# EAGLE design Dev-PCB (EAGLE 6.6.0) (continued)
## Board (continued)
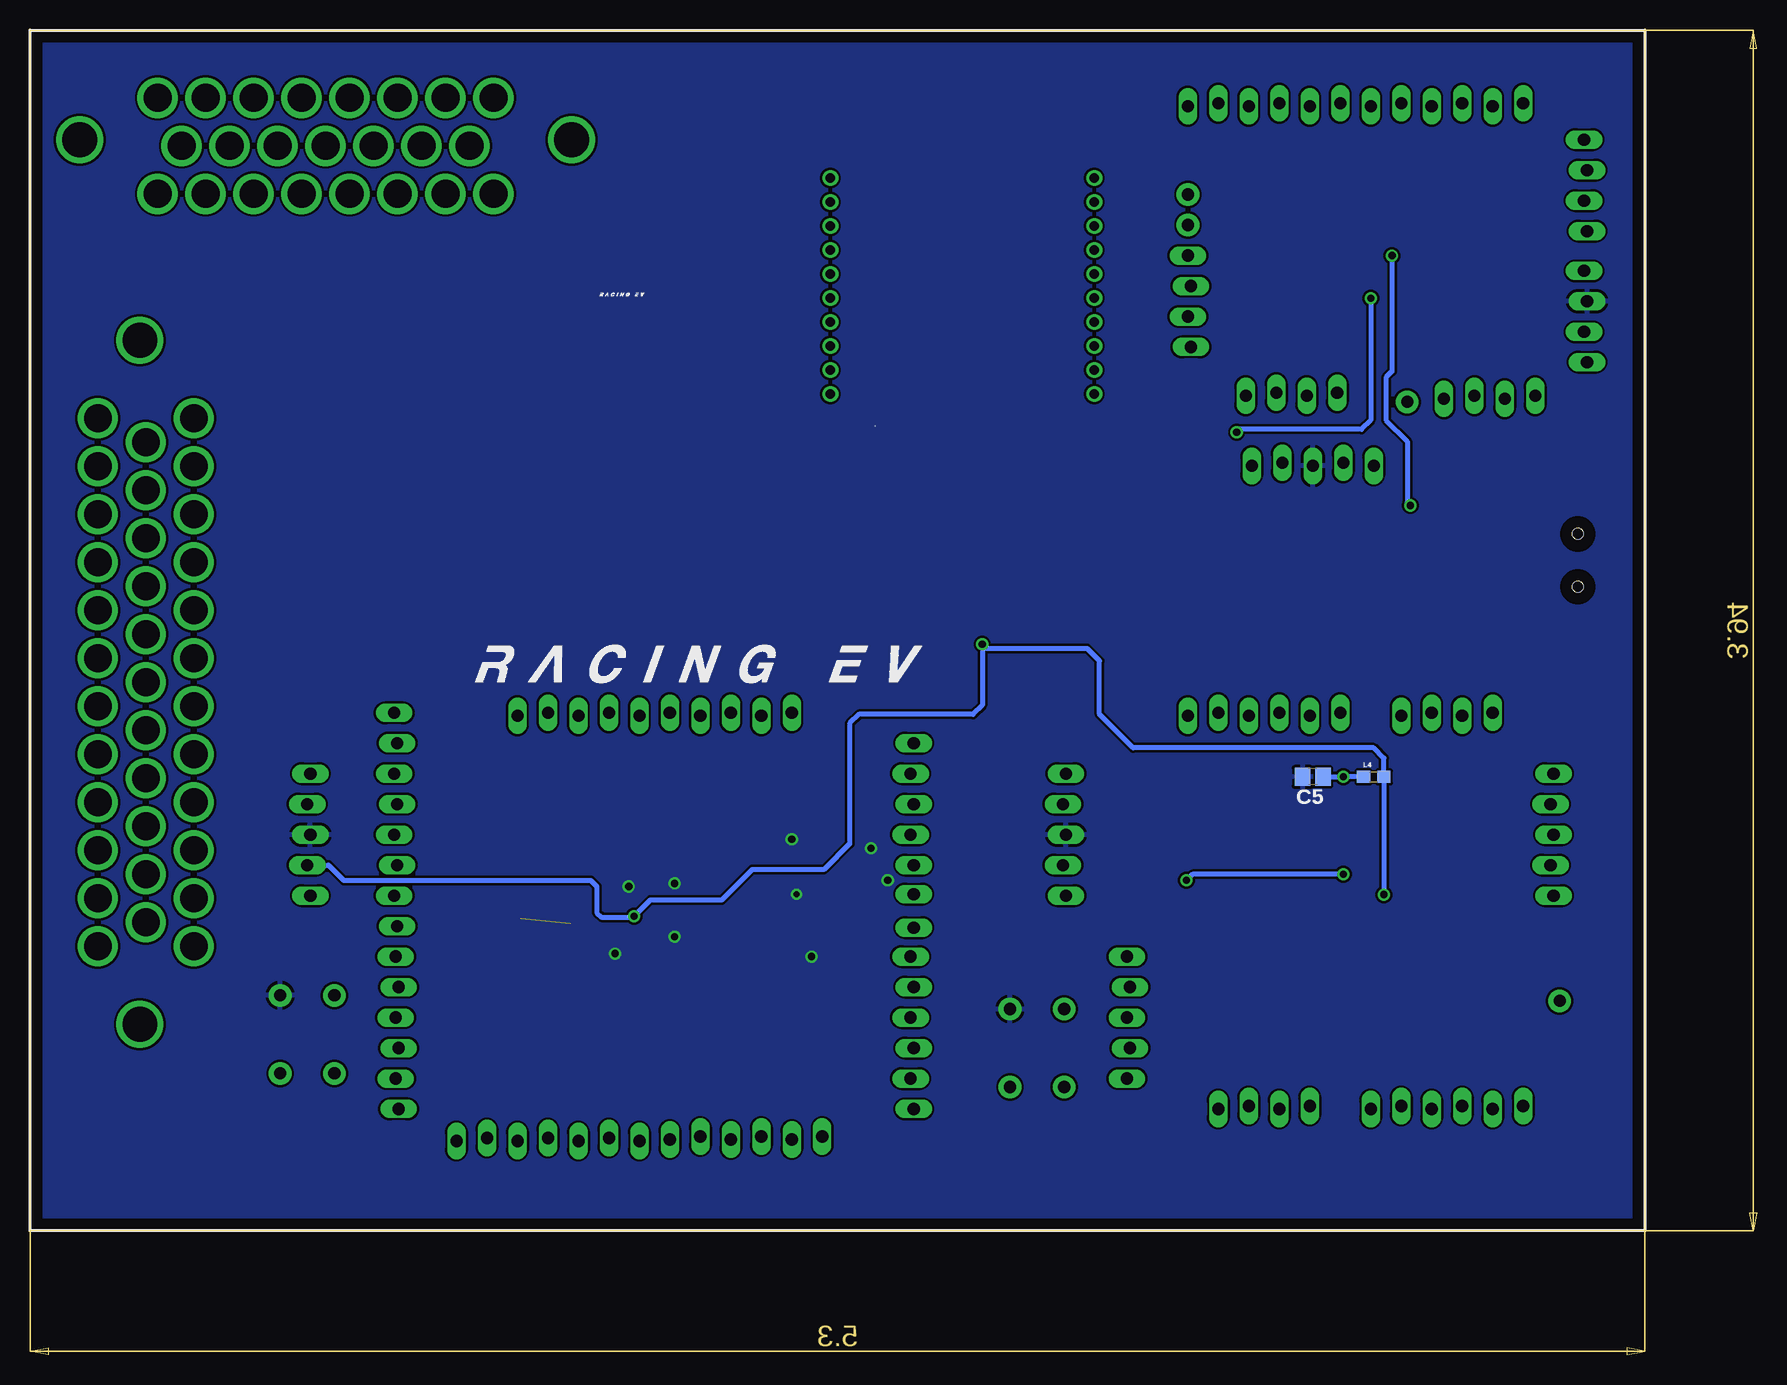
[diagram p3: board, bottom side, seen from below]

Size 134.62 x 100.08 mm. Coordinates in mm from the lower left corner, seen from the top.
Outline: 0,0 134.62,0 134.62,100.08 0,100.08 0,0
Copper layers (1*16): Top 0.035mm / dielectric 1.5mm / Bottom 0.035mm
Design rules "default": minimum track width 10mil, minimum drill 24mil, track to track 8mil, track to pad 8mil, pad to pad 8mil, via to via 8mil, smd to smd 8mil, copper to edge 40mil, drill to drill 8mil, minimum pad ring 10mil, minimum via ring 8mil, stop-mask expansion 4mil, vias tented up to drill 0mil, thermal gap 10mil

### Footprints (pad centres in the part's own frame; a part is rotated, then mirrored left to right if it is on the bottom)
C0805 = smd 1.3 x 1.5: 1 -0.85,0; 2 0.85,0
EIA3216 = smd 1.4 x 1.6: A 1.4,0; C -1.4,0
EIA7343 = smd 2.55 x 2.7: A 3.17,0; C -3.17,0
0805 = smd 0.8 x 1.2: 1 -0.9,0; 2 0.9,0
1-770669-1 = drill 2.35: 1 -14,4; 2 -10,4; 3 -6,4; 4 -2,4; 5 2,4; 6 6,4; 7 10,4; 8 14,4; 9 -12,0; 10 -8,0; 11 -4,0; 12 0,0; 13 4,0; 14 8,0; 15 12,0; 16 -14,-4; 17 -10,-4; 18 -6,-4; 19 -2,-4; 20 2,-4; 21 6,-4; 22 10,-4; 23 14,-4 | drill 2.9: 24 -20.5,-0.5; 25 20.5,-0.5
1-776163-2 = drill 2.3: 1 -22,4; 2 -18,4; 3 -14,4; 4 -10,4; 5 -6,4; 6 -2,4; 7 2,4; 8 6,4; 9 10,4; 10 14,4; 11 18,4; 12 22,4; 13 -20,0; 14 -16,0; 15 -12,0; 16 -8,0; 17 -4,0; 18 0,0; 19 4,0; 20 8,0; 21 12,0; 22 16,0; 23 20,0; 24 -22,-4; 25 -18,-4; 26 -14,-4; 27 -10,-4; 28 -6,-4; 29 -2,-4; 30 2,-4; 31 6,-4; 32 10,-4; 33 14,-4; 34 18,-4; 35 22,-4 | drill 2.88: TH1 -28.5,-0.5; TH2 28.5,-0.5
1X04_LOCK_LONGPADS = drill 1.016 long: 1 0,0; 2 2.54,-0.254; 3 5.08,0; 4 7.62,-0.254
1X05_LOCK_LONGPADS = drill 1.016 long: 1 0,0; 2 2.54,-0.254; 3 5.08,0; 4 7.62,-0.254; 5 10.16,0
1X01 = drill 1.016 pad 1.88: 1 0,0
1X06_LOCK_LONGPADS = drill 1.016 long: 1 0,0; 2 2.54,-0.254; 3 5.08,0; 4 7.62,-0.254; 5 10.16,0; 6 12.7,-0.254
1X08_LOCK_LONGPADS = drill 1.016 long: 1 0,0.127; 2 2.54,-0.127; 3 5.08,0.127; 4 7.62,-0.127; 5 10.16,0.127; 6 12.7,-0.127; 7 15.24,0.127; 8 17.78,-0.127
1X02_LOCK_LONGPADS = drill 1.016 long: 1 -0.127,0; 2 2.667,0
1X07_LOCK_LONGPADS = drill 1.016 long: 1 0,0.127; 2 2.54,-0.127; 3 5.08,0.127; 4 7.62,-0.127; 5 10.16,0.127; 6 12.7,-0.127; 7 15.24,0.127
0603 = smd 1.1 x 1: 1 -0.85,0; 2 0.85,0
CHIP-LED0805 = smd 1.2 x 1.2: A 0,-1.05; C 0,1.05
R0805 = smd 1.1 x 1.4: 1 -1,0; 2 1,0
TACTILE-PTH = drill 1.016 pad 1.88: 1 -3.251,2.261; 2 3.251,2.261; 3 -3.251,-2.261; 4 3.251,-2.261
TQFP-64 = smd 0.22 x 1: 1 -3.75,-5.75; 2 -3.25,-5.75; 3 -2.75,-5.75; 4 -2.25,-5.75; 5 -1.75,-5.75; 6 -1.25,-5.75; 7 -0.75,-5.75; 8 -0.25,-5.75; 9 0.25,-5.75; 10 0.75,-5.75; 11 1.25,-5.75; 12 1.75,-5.75; 13 2.25,-5.75; 14 2.75,-5.75; 15 3.25,-5.75; 16 3.75,-5.75; 33 3.75,5.75; 34 3.25,5.75; 35 2.75,5.75; 36 2.25,5.75; 37 1.75,5.75; 38 1.25,5.75; 39 0.75,5.75; 40 0.25,5.75; 41 -0.25,5.75; 42 -0.75,5.75; 43 -1.25,5.75; 44 -1.75,5.75; 45 -2.25,5.75; 46 -2.75,5.75; 47 -3.25,5.75; 48 -3.75,5.75 | smd 1 x 0.22: 17 5.75,-3.75; 18 5.75,-3.25; 19 5.75,-2.75; 20 5.75,-2.25; 21 5.75,-1.75; 22 5.75,-1.25; 23 5.75,-0.75; 24 5.75,-0.25; 25 5.75,0.25; 26 5.75,0.75; 27 5.75,1.25; 28 5.75,1.75; 29 5.75,2.25; 30 5.75,2.75; 31 5.75,3.25; 32 5.75,3.75; 49 -5.75,3.75; 50 -5.75,3.25; 51 -5.75,2.75; 52 -5.75,2.25; 53 -5.75,1.75; 54 -5.75,1.25; 55 -5.75,0.75; 56 -5.75,0.25; 57 -5.75,-0.25; 58 -5.75,-0.75; 59 -5.75,-1.25; 60 -5.75,-1.75; 61 -5.75,-2.25; 62 -5.75,-2.75; 63 -5.75,-3.25; 64 -5.75,-3.75
CAM-M8Q = smd 1.5 x 0.7: 1 4.4,0; 2 4.4,1; 3 4.4,2; 4 4.4,3; 5 4.4,4; 6 4.4,5; 7 4.4,6; 8 4.4,7; 9 4.4,8; 10 4.4,9; 11 4.4,10; 12 4.4,11; 15 -4.4,11; 16 -4.4,10; 17 -4.4,9; 18 -4.4,8; 19 -4.4,7; 20 -4.4,6; 21 -4.4,5; 22 -4.4,4; 23 -4.4,3; 24 -4.4,2; 25 -4.4,1; 26 -4.4,0 | smd 1.5 x 1: 13 4.4,12.15; 14 -4.4,12.15 | smd 0.7 x 1.5: 27 -2,-0.35; 28 -1,-0.35; 29 0,-0.35; 30 1,-0.35; 31 2,-0.35
RM024-TH = drill 0.8: 1 9,11; 2 7,11; 3 5,11; 4 3,11; 5 1,11; 6 -1,11; 7 -3,11; 8 -5,11; 9 -7,11; 10 -9,11; 11 -9,-11; 12 -7,-11; 13 -5,-11; 14 -3,-11; 15 -1,-11; 16 1,-11; 17 3,-11; 18 5,-11; 19 7,-11; 20 9,-11
DPAK = smd 1.6 x 3: 1 -2.28,-4.04; 3 2.28,-4.04 | smd 4.826 x 5.715: 2 0,2.858
SR-FRS-1W = smd 2.5 x 2.5: 1 0,31.1; 2 0.04,26.72; 3 0.04,22.32; 4 0.04,17.82; 5 0.04,13.32; 6 0.04,8.92; 7 0.04,4.42; 8 2.54,0.02; 9 7.14,0.02; 10 11.74,0.02; 11 16.34,0.02; 12 18.84,4.42; 13 18.94,8.82; 14 18.94,13.32; 15 18.94,17.82; 16 18.94,22.22; 17 18.84,26.72; 18 18.84,31.12
TQFP-44 = smd 1.5 x 0.5: 1 -5.8,4; 2 -5.8,3.2; 3 -5.8,2.4; 4 -5.8,1.6; 5 -5.8,0.8; 6 -5.8,0; 7 -5.8,-0.8; 8 -5.8,-1.6; 9 -5.8,-2.4; 10 -5.8,-3.2; 11 -5.8,-4; 23 5.8,-4; 24 5.8,-3.2; 25 5.8,-2.4; 26 5.8,-1.6; 27 5.8,-0.8; 28 5.8,0; 29 5.8,0.8; 30 5.8,1.6; 31 5.8,2.4; 32 5.8,3.2; 33 5.8,4 | smd 0.5 x 1.5: 12 -4,-5.8; 13 -3.2,-5.8; 14 -2.4,-5.8; 15 -1.6,-5.8; 16 -0.8,-5.8; 17 0,-5.8; 18 0.8,-5.8; 19 1.6,-5.8; 20 2.4,-5.8; 21 3.2,-5.8; 22 4,-5.8; 34 4,5.8; 35 3.2,5.8; 36 2.4,5.8; 37 1.6,5.8; 38 0.8,5.8; 39 0,5.8; 40 -0.8,5.8; 41 -1.6,5.8; 42 -2.4,5.8; 43 -3.2,5.8; 44 -4,5.8
USB-MINIB = smd 2.5 x 0.5: D+ 2.5,0; D- 2.5,0.8; GND 2.5,-1.6; ID 2.5,-0.8; VBUS 2.5,1.6 | smd 2.5 x 2: MTN1 -3,4.5; MTN2 2.5,4.5; MTN3 -3,-4.5; MTN4 2.5,-4.5 | hole 0.9: 0,2.2; 0,-2.2
CRYSTAL-SMD-5X3 = smd 1.9 x 1.1: 1 -1.85,-1.15; 2 1.85,-1.15; 3 1.85,1.15; 4 -1.85,1.15

### Placement (x,y rotation side)
C1  16.26,62.23 180 top
C2  12.19,80.52 180 top
C3  33.27,82.55 0 top
C4  83.57,14.73 90 top
C5  27.69,37.85 180 bottom
C6  51.82,25.02 270 top
C7  13.72,55.12 90 top
C8  7.11,23.62 90 top
C9  72.64,27.18 180 top
C10  92.84,26.04 0 top
C11  83.57,34.16 270 top
C12  39.62,32.26 180 top
C13  83.31,11.05 180 top
C14  113.67,23.24 270 top
C15  66.17,28.83 180 top
C16  66.55,22.86 0 top
C17  36.07,52.58 270 top
C18  15.75,27.56 180 top
C19  25.91,18.54 270 top
C24  15.49,23.62 270 top
C40  39.62,52.07 90 top
J1  109.98,90.42 180 top
J2  124.97,45.72 90 top
JP1  10.16,93.98 0 top
JP2  20.32,93.98 0 top
JP3  32.77,63.75 180 top
JP4  30.48,93.98 0 top
JP5  38.1,81.28 270 top
JP6  4.83,83.31 90 top
JP7  4.83,72.39 90 top
JP8  16.76,69.34 180 top
JP9  33.27,69.6 180 top
JP10  38.1,86.36 0 top
JP11  38.1,83.82 0 top
JP12  19.81,69.09 0 top
JP13  48.26,27.94 90 top
JP14  43.18,22.86 270 top
JP15  35.56,10.16 180 top
JP16  25.4,43.18 0 top
JP17  12.7,43.18 0 top
JP18  22.86,10.16 180 top
JP19  7.11,19.18 180 top
JP20  7.62,27.94 90 top
JP21  111.25,27.94 90 top
JP22  81.28,7.62 180 top
JP23  60.96,10.16 90 top
JP24  104.14,22.86 270 top
JP25  71.12,43.18 0 top
JP26  104.14,43.18 270 top
JP27  86.36,43.18 0 top
JP28  60.96,30.48 90 top
JP29  60.96,25.4 90 top
JP30  99.06,7.62 180 top
L4  22.61,37.85 0 bottom
LED1  37.34,70.61 270 top
LED2  68.83,36.32 0 top
LED3  19.81,52.07 180 top
LED7  5.21,44.2 0 top
LED10  31.24,56.39 0 top
R1  114.55,28.83 90 top
R3  51.69,28.96 90 top
R8  31.5,66.8 180 top
R10  33.78,72.9 180 top
R14  73.53,33.15 0 top
R16  41.27,29.34 180 top
R22  31.24,52.07 270 top
R24  19.81,56.9 90 top
R25  110.74,24.13 180 top
R39  8.26,43.18 0 top
S1  50.67,15.24 270 top
S2  111.51,16.38 270 top
U1  83.82,25.4 90 top
U2  55.88,60.96 90 top
U3  56.9,78.74 90 top
U4  25.91,54.61 180 top
U5  62.99,58.17 0 top
U8  21.59,81.28 0 top
U12  25.4,27.94 180 top
U$1  5.59,55.88 0 top
U$2  88.65,77.47 0 bottom
U$3  112.52,41.66 0 bottom
U$4  32.64,61.59 180 top
U$5  45.97,27.94 90 top
U$6  109.09,27.94 90 top
Y1  11.43,23.62 0 top
Y2  67.44,25.78 180 top

### Tracks (layer width: path | path; a pad name or v marks a point on that pad's centre or on a via)
+3V3  (via drill 0.6)
  Top 0.203: C13.1 84.96,11.8 84.96,17.14 84.07,18.04 U1.57 84.07,20.32 84.2,20.45 84.2,25.53 84.58,25.91 | C10.1 91.82,26.15 U1.10 86.36,26.15 | 86.36,26.15 84.82,26.15 84.58,25.91 | 83.19,26.65 U1.38 74.7,26.65 74.17,27.18 C9.1 | 83.19,26.65 83.84,26.65 | v84.26,26.23 84.58,25.91 | 83.19,26.65 83.07,26.77 U1.26 83.07,32.02 83.57,32.51 C11.2 | U1.19 86.57,26.36 86.36,26.15 | JP21.2 114.06,30.48 R1.2
  Top 0.406: v84.26,26.23 83.84,26.65 | 22.1,27.94 U12.28 17.78,27.94 17.4,27.56 C18.1 | 22.1,27.94 24.89,27.94 26.16,26.67 26.16,22.18 U12.40 | v21.76,28.03 22.01,28.03 22.1,27.94 | U12.40 26.2,21 C19.1 | U12.40 26.2,25.69 | JP13.2 50.8,30.48 51.05,30.73 | 51.05,30.73 51.69,31.37 51.69,45.59 54.61,48.51 54.86,48.51 v55.24,48.9 | R3.2 51.69,30.1 51.05,30.73
  Top 1.016: U4.2 27.75,51.75 28.7,50.8 30.97,50.8 R22.2 35.96,51.07 C17.A 39.58,51.18 C40.1 52.92,51.22 v55.24,48.9
  Bottom 0.406: JP21.2 109.73,30.48 108.46,29.21 87.88,29.21 87.38,28.7 87.38,26.53 87,26.15 84.34,26.15 v84.26,26.23 82.93,27.56 76.96,27.56 74.42,30.1 68.45,30.1 66.29,32.26 66.29,42.29 65.53,43.05 56.01,43.05 55.24,43.81 v55.24,48.9 54.86,48.51 46.48,48.51 45.47,47.5 45.47,43.05 42.67,40.26 22.61,40.26 21.76,39.41 L4.2 v21.76,28.03 21.84,27.94
+5V  (via drill 0.6)
  Top 0.406: JP7.2 7.37,74.93 8.38,75.95 8.38,77.47 9.91,78.99 12.45,78.99 12.95,79.5 12.95,80.43 C2.1 13.08,80.48 U8.7 20.28,80.48 v21.08,81.28 U8.28 29.97,81.28 31.24,82.55 C3.1 | R8.2 30.23,66.43 JP3.2 30.23,61.98 29.72,61.47 24.38,61.47 23.63,60.71 U4.3 | R24.2 19.56,58.15 v19.56,60.45 19.81,60.71 19.81,61.98 19.56,62.23 C1.1
  Top 0.61: U$1.VBUS 9.98,57.48 10.67,58.17
  Top 1.016: 10.67,58.17 13.59,58.17 C7.A 19.42,58.29 R24.2 22.87,57.9 U4.3
  Bottom 0.406: v21.08,81.28 21.08,71.63 21.59,71.12 21.59,67.56 19.81,65.79 19.81,60.71 v19.56,60.45
GND  (via drill 0.5, 0.6)  (1 unrouted)
  Top 0.203: U1.41 78.86,25.15 78.87,25.15 | U1.25 83.57,30.35 84.2,29.72 85.6,29.72 86.07,30.19 U1.20 | U1.9 88.39,25.65 88.14,25.4
  other vias: 70.74,28.07 69.47,22.86 63.12,29.21 64.52,31.88 71.12,32.64 80.9,24.51 80.9,28.96 85.85,23.11 84.71,28.7
  pour Top: 0,100.08 134.62,100.08 134.62,0 0,0
  pour Bottom: 0,100.08 134.62,100.08 134.62,0 0,0
N$1
  Top 0.406: R10.1 34.78,71.14 35.31,70.61 LED1.A
N$2
  Top 0.406: U8.22 31.96,75.48 33.02,74.42 33.02,73.14 R10.2 32.78,70.09 JP9.1
N$3
  Top 0.406: JP1.1 10.16,91.44 14.48,87.12 17.55,87.12 U8.44
N$4
  Top 0.406: U8.43 18.39,88.29 18.03,88.65 14.99,88.65 12.7,90.93 JP1.2
N$5
  Top 0.406: U8.42 19.19,88.76 18.29,89.66 16.26,89.66 15.24,90.68 JP1.3
N$6
  Top 0.406: U8.41 19.99,88.98 17.78,91.19 JP1.4
N$7
  Top 0.406: U8.40 20.79,91.22 20.32,91.69 JP2.1
N$8
  Top 0.406: U8.39 21.59,90.42 22.86,91.69 JP2.2
N$9
  Top 0.406: U8.38 22.39,89.7 24.13,91.44 24.89,91.44 25.4,91.95 JP2.3
N$10
  Top 0.406: U8.37 23.19,89.23 24.64,90.68 26.92,90.68 27.94,91.69 JP2.4
N$11
  Top 0.406: U8.36 23.99,88.76 25.15,89.92 29.21,89.92 30.48,91.19 JP4.1
N$12
  Top 0.406: U8.35 24.79,88.29 25.65,89.15 31.5,89.15 33.02,90.68 JP4.2
N$13
  Top 0.406: U8.32 29.11,84.48 29.97,85.34 29.97,87.38 30.73,88.14 33.53,88.14 35.56,90.17 JP4.3
N$14
  Top 0.406: U8.31 29.58,83.68 30.99,85.09 30.99,86.87 31.5,87.38 34.29,87.38 38.1,91.19 JP4.4
N$15
  Top 0.203: LED2.A 71.79,35.27 72.52,34.54 72.52,33.26 R14.1
N$16
  Top 0.406: U8.26 35.23,79.68 36.83,81.28 JP5.1
N$17
  Top 0.406: U8.25 35.93,78.88 36.07,78.74 JP5.2
N$18
  Top 0.406: U8.24 34.7,78.08 36.58,76.2 JP5.3
N$19
  Top 0.305: LED10.A R22.1
N$20
  Top 0.406: U8.23 33.72,77.28 36.07,74.93 36.07,74.42 36.83,73.66 JP5.4
N$21
  Top 0.406: U8.4 10.59,82.88 10.16,83.31 JP6.1
N$22
  Top 0.406: U8.3 11.32,83.68 9.14,85.85 JP6.2
N$23
  Top 0.406: U8.2 12.8,84.48 8.89,88.39 JP6.3
N$24
  Top 0.406: U8.1 13.27,85.28 7.62,90.93 JP6.4
N$25
  Top 0.305: R24.1 LED3.A
N$26
  Top 0.406: U8.8 14.4,79.68 12.95,78.23 10.41,78.23 9.4,77.22 9.4,73.41 8.38,72.39 JP7.1
N$27
  Top 0.406: U8.5 9.69,82.08 7.62,80.01 JP7.4
N$28
  Top 0.406: U8.14 19.19,74.31 18.8,73.91 17.53,73.91 16.76,73.15 JP8.1
N$29
  Top 0.406: U8.11 15.79,77.26 14.22,75.69 JP8.2
N$30
  Top 0.406: U8.10 14.83,78.08 13.21,76.45 12.19,76.45 11.68,75.95 JP8.3
N$31
  Top 0.406: U8.9 14.62,78.88 13.21,77.47 10.92,77.47 10.16,76.71 10.16,70.61 JP8.4
N$32
  Top 0.406: U8.21 24.79,74.27 25.15,73.91 29.97,73.91 30.73,73.15 JP9.2
N$33
  Top 0.406: U8.20 23.99,73.55 24.38,73.15 27.69,73.15 28.19,72.64 JP9.3
N$34
  Top 0.406: U8.19 23.19,73.08 23.88,72.39 25.15,72.39 25.65,71.88 JP9.4
N$35
  Top 0.406: U8.30 29.79,82.88 33.27,86.36 JP10.1
N$36
  Top 0.406: U8.27 34.76,80.48 35.81,81.53 35.81,83.06 36.58,83.82 JP11.1
N$37
  Top 0.406: JP12.1 19.81,70.61 20.07,70.87 20.07,75.4 U8.15
N$38
  Top 0.406: LED7.A 7.32,43.15 R39.1
N$39
  Top 0.406: Y1.3 15.24,24.77 C24.1 15.86,24.89 16.51,24.89 17.16,25.54 U12.31
N$40
  Top 0.406: U8.17 21.59,74.17 22.1,73.66 22.1,72.39 23.37,71.12 23.37,68.33 25.15,66.55 JP3.4
N$41
  Top 0.406: U12.30 11.86,26.34 11.43,25.91 11.43,22.86 10.92,22.35 9.46,22.35 | 8.89,22.35 9.46,22.35 | 9.46,22.35 Y1.1 9.33,22.72 C8.1
N$42  (via drill 0.6)
  Top 0.406: v25.15,37.85 25.15,35.56 25.4,35.31 U12.17
  Bottom 0.406: L4.1 v25.15,37.85 C5.1
N$43
  Top 0.406: U8.16 20.79,73.95 21.34,73.41 21.34,71.88 22.61,70.61 JP3.5
N$44
  Top 0.406: U12.7 35.09,28.74 38.1,31.75 38.1,32.13 C12.A
N$45
  Top 0.406: U12.22 21.36,33.78 19.05,33.78 12.7,40.13 JP17.1 R39.2
N$46  (via drill 0.6)
  Top 0.406: R8.1 32.77,66.43 JP3.1 33.27,63.75 34.04,64.52 v34.04,66.55 | U8.18 22.39,77.25 v22.86,77.72
  Bottom 0.406: v22.86,77.72 22.86,67.56 23.62,66.8 33.78,66.8 v34.04,66.55
N$47
  Top 0.406: R16.1 43.69,29.34 45.09,27.94 JP13.1 | JP13.1 48.38,28.06 R3.1 51.69,26 C6.1 | S1.3 48.41,27.79 JP13.1
N$48  (via drill 0.6)
  Top 0.406: U12.18 24.6,30.26 v25.15,29.72 | v38.23,29.21 40.25,29.21 R16.2
  Bottom 0.406: v25.15,29.72 37.72,29.72 v38.23,29.21
N$49
  Top 0.406: U12.8 33.86,29.54 36.07,31.75 36.07,34.04 37.59,35.56 JP13.4
N$50
  Top 0.406: U12.9 33.39,30.34 34.8,31.75 34.8,35.05 37.85,38.1 JP13.5
N$51
  Top 0.406: U12.5 41.44,27.14 43.18,25.4 JP14.1
N$52
  Top 0.406: U12.4 38.94,26.34 40.39,24.89 40.39,20.57 40.64,20.32 JP14.2
N$53
  Top 0.406: U12.3 38.47,25.54 39.5,24.51 39.5,18.54 40.26,17.78 42.55,17.78 42.67,17.91 43.05,17.91 JP14.3
N$54
  Top 0.406: U12.2 38,24.74 38.73,24 38.73,16.26 39.75,15.24 JP14.4
N$55
  Top 0.406: U12.1 37.15,23.94 37.97,23.11 37.97,13.84 39.12,12.7 JP14.5
N$56
  Top 0.406: U12.44 29.4,21.15 29.72,20.83 29.72,14.73 30.1,14.35 34.42,14.35 35.56,13.21 JP15.1
N$57
  Top 0.406: U12.43 28.6,20.93 28.96,20.57 28.96,14.1 29.59,13.46 32.26,13.46 33.02,12.7 JP15.2
N$58
  Top 0.406: U12.42 27.8,20.71 28.32,20.19 28.32,13.34 29.08,12.57 30.35,12.57 30.61,12.32 30.61,10.29 JP15.3
N$59
  Top 0.406: U12.41 27,20.5 27.56,19.94 27.56,10.79 JP15.4
N$60
  Top 0.406: U12.15 27,39.8 25.4,41.66 JP16.1
N$61
  Top 0.406: U12.14 27.8,42.79 JP16.2
N$62
  Top 0.406: U12.13 28.6,38.51 30.48,40.39 JP16.3
N$63
  Top 0.406: U12.12 29.4,36.77 33.02,40.39 JP16.4
N$64
  Top 0.406: U12.11 31.2,36.53 35.56,40.89 JP16.5
N$65
  Top 0.406: U12.10 32.41,31.14 33.27,32 33.27,35.81 38.1,40.64 JP16.6
N$66
  Top 0.406: U12.21 22.2,34.95 21.84,35.31 20.07,35.31 15.24,40.13 JP17.2
N$67
  Top 0.406: U12.20 23,35.42 17.78,40.64 JP17.3
N$68
  Top 0.406: U12.19 23.8,36.65 20.32,40.13 JP17.4
N$69
  Top 0.406: JP18.1 22.86,11.18 24.64,12.95 24.64,22.1 U12.38
N$70
  Top 0.406: U12.37 23.8,14.02 22.73,12.95 20.7,12.95 20.32,12.57 JP18.2
N$71
  Top 0.406: U12.36 23,14.74 22.23,13.97 18.8,13.97 17.78,12.95 JP18.3
N$72
  Top 0.406: U12.35 22.2,15.34 21.72,14.86 16.51,14.86 15.24,13.59 JP18.4
N$73
  Top 0.406: U12.34 21.4,16.19 21.08,15.88 15.24,15.88 12.7,13.34 JP18.5
N$74
  Top 0.406: U12.33 19.6,17.57 19.18,17.14 12.7,17.14 10.16,14.61 JP18.6
N$75
  Top 0.406: U12.32 18.26,24.74 17.65,24.13 17.65,20.07 16.76,19.18 JP19.1
N$76
  Top 0.406: U12.27 13.25,28.74 12.45,27.94 JP20.1
N$77
  Top 0.406: U12.26 13.89,29.54 12.95,30.48 JP20.2
N$78
  Top 0.406: U12.25 16.14,30.34 13.46,33.02 JP20.3
N$79
  Top 0.406: U12.24 16.87,31.14 12.45,35.56 JP20.4
N$80
  Top 0.406: JP20.5 12.19,38.1 18.29,32 19.54,32 U12.23
N$81
  Top 0.203: U1.32 75.53,31.15 74.42,32.26 74.42,33.14 R14.2 74.43,34.28 72.64,36.07 71.63,36.07 71.12,36.58 JP25.1
N$82
  Top 0.203: U1.40 67.81,25.65 66.8,24.64 Y2.3 65.65,24.57 C16.1
N$83
  Top 0.203: C15.1 67.39,28.83 Y2.1 69.21,26.93 69.98,26.16 78.06,26.16 U1.39
N$85
  Top 0.203: U1.55 83.07,17.92 81.15,16 81.15,7.75 JP22.1
N$86
  Top 0.203: R25.1 111.64,27.55 JP21.1 114.8,27.94 R1.1
  Top 0.406: S2.3 109.25,21.61 109.73,22.1 111.25,22.1 111.63,22.48 111.63,24.12 R25.1 C14.1
N$87
  Top 0.203: U1.7 92.19,24.65 93.34,23.5 101.85,23.5 102.49,24.13 R25.2
N$88
  Top 0.203: U1.56 C4.A
N$89
  Top 0.203: U1.54 82.57,18.18 80.77,16.38 79.38,16.38 78.74,15.75 JP22.2
N$90
  Top 0.203: U1.15 90.37,28.65 90.81,29.08 98.55,29.08 100.58,31.11 100.58,34.67 101.47,35.56 JP26.4
  Top 0.406: JP26.4 JP21.4
N$91
  Top 0.203: U1.16 89.6,29.15 90.17,29.72 98.3,29.72 99.95,31.37 99.95,36.96 100.97,37.97 104.14,37.97 JP26.3
  Top 0.406: JP26.3 JP21.5
N$92
  Top 0.203: U1.53 82.07,18.32 80.64,16.89 77.6,16.89 76.33,15.62 76.33,7.75 JP22.3
N$93
  Top 0.203: U1.52 81.57,18.58 80.52,17.53 77.22,17.53 73.91,14.22 73.91,8.13 JP22.4
N$94
  Top 0.203: U1.51 81.07,18.71 80.39,18.03 76.71,18.03 71.25,12.57 71.25,7.75 JP22.5
N$95
  Top 0.203: U1.50 80.57,18.85 80.26,18.54 76.33,18.54 72.64,14.86 69.47,14.86 68.71,14.1 68.71,8 JP22.6
N$96
  Top 0.203: U1.49 76.55,19.65 72.9,16 65.79,16 65.41,15.62 65.41,11.3 64.26,10.16 JP23.1
N$97
  Top 0.203: JP23.2 63.5,12.7 64.9,14.1 64.9,16.13 65.28,16.51 72.64,16.51 74.3,18.16 74.3,21.08 74.86,21.65 U1.48
N$98
  Top 0.203: U1.47 73.97,22.15 73.66,21.84 73.66,18.41 72.26,17.02 64.77,17.02 63.12,15.37 61.09,15.37 JP23.3
N$99
  Top 0.203: U1.46 73.58,22.65 73.15,22.23 73.15,19.05 71.88,17.78 JP23.4
N$100
  Top 0.203: JP23.5 64.14,20.32 64.52,19.94 70.61,19.94 72.64,21.97 72.64,22.86 72.93,23.15 U1.45
N$101
  Top 0.203: JP23.6 62.36,22.86 64.64,20.57 70.36,20.57 72.01,22.23 72.01,23.37 72.29,23.65 U1.44
N$102
  Top 0.203: U1.6 91.8,24.15 93.09,22.86 JP24.1
N$103
  Top 0.203: U1.5 91.28,23.65 92.84,22.1 92.84,20.7 93.22,20.32 JP24.2
N$104
  Top 0.203: U1.4 90.9,23.15 92.08,21.97 92.08,18.92 93.22,17.78 JP24.3
N$105
  Top 0.203: U1.3 90.76,22.65 91.57,21.84 91.57,16 92.33,15.24 JP24.4
N$106
  Top 0.203: U1.2 90.5,22.15 90.81,21.84 90.81,14.1 91.69,13.21 98.42,13.21 98.93,12.7 JP24.5
N$107
  Top 0.203: U1.1 89.57,13.81 90.81,12.57 97.79,12.57 100.2,10.16 JP24.6
N$108
  Top 0.203: U1.31 80.57,32.08 80.14,32.51 77.09,32.51 75.69,33.91 75.69,35.05 73.66,37.08 JP25.2
N$109
  Top 0.203: U1.30 81.07,32.34 80.26,33.15 77.22,33.15 76.2,34.16 JP25.3
N$110
  Top 0.203: U1.29 81.57,32.6 80.26,33.91 79.25,33.91 78.74,34.42 JP25.4
N$111
  Top 0.203: U1.28 82.07,32.99 81.28,33.78 JP25.5
N$112
  Top 0.203: U1.27 82.57,33.38 82.04,33.91 82.04,39.5 83.82,41.27 JP25.6
N$113
  Top 0.203: U1.18 87.07,31.95 87.38,32.26 97.79,32.26 98.55,33.02 98.55,41.53 100.2,43.18 JP26.1
N$114
  Top 0.203: U1.17 98.46,31.15 99.44,32.13 99.44,39.37 100.71,40.64 JP26.2
N$115
  Top 0.203: U1.14 90.51,28.15 90.93,28.57 98.81,28.57 101.09,30.86 101.09,32.64 101.47,33.02 JP26.5
N$116
  Top 0.203: U1.13 90.64,27.65 91.06,28.07 99.44,28.07 101.85,30.48 JP26.6
N$117
  Top 0.203: U1.12 90.78,27.15 91.19,27.56 103.89,27.56 JP26.7
N$118
  Top 0.203: U1.11 91.04,26.65 91.44,27.05 99.44,27.05 101.09,25.4 JP26.8
N$119
  Top 0.203: U1.24 84.07,32 84.71,32.64 84.71,39.12 86.36,40.77 JP27.1
N$120
  Top 0.203: U1.23 84.57,31.86 85.22,32.51 85.22,38.61 86.87,40.26 88.27,40.26 88.9,40.89 JP27.2
N$121
  Top 0.203: U1.22 85.07,31.73 85.72,32.38 85.72,38.35 87.12,39.75 90.3,39.75 91.44,40.89 JP27.3
N$122
  Top 0.203: U1.21 85.57,31.72 86.23,32.38 86.23,37.97 87.38,39.12 92.58,39.12 93.98,40.51 JP27.4
N$123
  Top 0.203: U1.37 75.08,27.15 73.28,28.96 68.71,28.96 67.18,30.48 JP28.1
N$124
  Top 0.203: U1.36 75.22,27.65 73.41,29.46 69.09,29.46 65.53,33.02 JP28.2
N$125
  Top 0.203: U1.35 75.61,28.15 73.66,30.1 69.34,30.1 66.04,33.4 66.04,35.18 65.66,35.56 JP28.3
N$126
  Top 0.203: U1.34 75.87,28.65 73.79,30.73 69.47,30.73 66.67,33.53 66.67,37.59 66.17,38.1 JP28.4
N$127
  Top 0.203: U1.33 76.13,29.15 74.04,31.24 69.72,31.24 67.31,33.66 67.31,38.99 65.66,40.64 JP28.5
N$128
  Top 0.203: JP29.1 62.87,25.27 63.37,24.77 63.37,22.61 64.9,21.08 70.1,21.08 71.37,22.35 71.37,23.75 71.44,23.81 71.75,24.13 71.78,24.15 U1.43
N$129
  Top 0.203: JP29.2 63.37,28.07 63.88,27.56 63.88,22.73 65.02,21.59 69.85,21.59 70.87,22.61 70.87,24 71.5,24.64 78.06,24.64 U1.42
N$130
  Top 0.203: U1.64 87.57,19.24 88.65,18.16 88.65,12.32 89.03,11.94 97.16,11.94 99.06,10.03 JP30.1
N$131
  Top 0.203: U1.63 87.07,18.98 88.01,18.03 88.01,11.68 88.27,11.43 95.38,11.43 96.52,10.29 JP30.2
N$132
  Top 0.203: U1.62 86.57,18.84 87.5,17.91 87.5,11.3 87.88,10.92 93.09,10.92 93.85,10.16 93.85,7.62 JP30.3
N$133
  Top 0.203: U1.61 86.07,18.7 87,17.78 87,10.79 87.38,10.41 90.93,10.41 91.44,9.91 JP30.4
N$134
  Top 0.203: U1.60 85.57,18.57 86.49,17.65 86.49,10.41 87,9.91 88.39,9.91 88.9,9.4 JP30.5
N$135
  Top 0.203: U1.59 85.07,18.43 85.98,17.53 85.98,8.13 JP30.6
N$136
  Top 0.203: U1.58 84.57,18.3 85.47,17.4 85.47,10.29 83.82,8.64 JP30.7

### Text on the board
tPlace: To: Zac Kilburn | From: Rich Johnson
_tsilk: JP1 | JP2 | JP4 | 1 | JP10 | U8 | C3 | JP11 | JP5 | JP6 | C2 | R10 | To: Zac Kilburn | + | JP7 | JP12 | From: Rich Johnson | JP9 | LED1 | JP8 | R8 | C1 | JP3 | U5 | U$1 | U4 | U2 | R24 | + | C17 | C7 | LED3 | + | C40 | LED10 | R22 | JP17 | JP16 | R39 | LED7 | JP26 | + | JP25 | JP27 | C11 | JP21 | + | LED2 | R14 | C12 | JP28 | R16 | R3 | C15 | R1 | JP20 | C18 | JP29 | C10 | Y1 | C6 | C9 | U12 | C14 | C24 | JP14 | Y2 | JP24 | C8 | R25 | C16 | U1 | JP19 | C19 | S2 | S1 | C4 | C13 | JP23 | JP18 | JP15 | JP22 | JP30
_bsilk: S:/GoogleDrive/FSAE/2015/Subsystem Control/Logo/Zip-fixed.bmp | S:/GoogleDrive/FSAE/2015/Subsystem Control/Logo/Zip-fixed.bmp | L4 | C5